# EAGLE board yrl040-bugfix1 (EAGLE 9.4.2), part 1 of 2 (continued)
## Tracks (layer width: path | path; a pad name or v marks a point on that pad's centre or on a via) (continued)
  Top 0.25: v30.4,68.9 30.5,68.9 30.8,69.2 36.45,69.2 37.25,70 37.25,70.5 36.9,70.85 36.05,70.85 v36,70.9 | v53.4,81 53,81 52.24,80.24 48.34,80.24 47.01,78.91 47.01,78.84 44.56,76.4 v43.8,76.4 43.8,75.1 v47.1,71.8
  Top 0.254: 38.9,3.7 39.6,3.7 v39.9,3.4
  Top 0.3: LED5.1 5.15,83.9 5.37,83.9 5.55,84.08 5.55,86.03 5.6,86.08
  Top 0.305: J19.+5V 20.54,81.96 19.57,82.94 14.52,82.94 13.45,84 13.45,85.03 12.61,85.88 12.2,85.88 12,86.08 5.6,86.08 2.15,86.08 v2.06,86.17 | 32.57,4 38.01,4 38.31,3.7 38.9,3.7
  Top 0.406: v3.69,9.09 1.25,6.65 v1.15,6.65 | J5.V+_1 34.74,29.6 33.94,30.4 30.73,30.4 29.93,29.6 J4.V+_1 27.34,29.6 26.54,30.4 23.33,30.4 22.53,29.6 J3.V+_1 20.05,29.6 19.24,30.4 15.93,30.4 15.13,29.6 J2.V+_1 14.39,29 v4.19,29 | J10.3-VCC J11.3-VCC J12.3-VCC J13.3-VCC J14.3-VCC J15.3-VCC | v26,4.4 26,7.02 27.2,8.22 27.2,8.97 27.93,9.7 28.97,9.7 31.22,7.45 31.22,6.81 31.62,6.41 31.67,6.41 32.57,5.51 32.57,4 32.57,1.86 v33.8,0.62
  Bottom 0.15: 4.3,8.9 3.87,8.9 v3.69,9.09 | U9.8 49.39,14.64 49.66,14.37 55.02,14.37 55.05,14.4 | 55.1,28.1 50.1,28.1 49.9,28.3 U10.7 U10.8 | RA2.P$2 RA2.P$1 14.4,33.2 v12.6,31.4 | IC2.4 33.93,77.15 33.93,76.72 34.06,76.58 34.81,76.58 34.94,76.72 34.94,77.15 IC2.6 | 55.34,57.4 C31.1 | 25.95,80.25 RA10.P$4 | v31.8,76.1 31.32,76.58 30.86,76.58 30.2,77.25 30.2,79.25 C29.1 | IC1.4 43.85,76.45 v43.8,76.4 | U8.7 5.88,28.97 5.88,29.66 5.75,29.79 5.29,29.79 4.5,29 v4.19,29
  Bottom 0.2: 53.4,85.5 53.36,85.54 | IC2.6 35.22,77.43 v35.22,76.58 | v36,70.9 36,68.89 IC2.18 | IC2.4 33.64,76.64 33.52,76.53 32.47,76.53 32.04,76.1 v31.8,76.1 | 25.95,80.25 25.66,79.96 25.66,79.8 25.51,79.65 23.29,79.65 23.14,79.8 23.14,80.52 J19.+5V | IC1.20 46.89,70.28 46.89,69.48 46.51,69.1 44.6,69.1 44.35,68.85 C32.1 | RA10.P$4 26.1,80.4 v27.65,80.4 | 39.4,0.37 39.51,0.37 39.65,0.5
  Bottom 0.24: 40.2,0.5 40.1,0.5 | v33.8,0.62 34.05,0.37 39.4,0.37 | v26,4.4 C3.P$2
  Bottom 0.25: C28.1 v30.4,68.9 | 55.6,81 v53.4,81 | v47.1,71.8 IC1.20 | IC1.20 | 3.3,86.6 2.71,86.6 2.42,86.52 v2.06,86.17
  Bottom 0.254: U12.8 51.92,66.58 52.83,66.58 53.69,67.44 U11.5 53.92,67.5 55.6,67.5 | R19.1 5.95,73.25 5.15,72.45 5.15,64.1 5.17,64.08 | v39.9,3.4 40.6,2.7 40.6,0.5
  Bottom 0.29: 5.83,37.5 6,37.67 U7.4 | 5.83,23.26 6,23.43 U8.4 | 50.07,20.9 49.9,20.73 U9.4 | 50.07,35.14 49.9,34.97 U10.4
  Bottom 0.3: 5.17,64.08 6.8,62.45 6.8,57.3 6.8,57.27 | 55.34,58.1 55.34,58.24 55.6,58.5 55.6,67.5 55.6,81 55.6,83.3 53.4,85.5 | 53.36,85.54 v53.34,85.56 52.3,86.6 3.3,86.6
  Bottom 0.305: U1.3 25.94,5.56 | 25.94,5.56 C3.P$2 | 25.94,5.56 25.94,5.71 27,6.78 27,8.22 26.82,8.4 25.18,8.4 24.21,7.44 U1.1
  Bottom 0.34: U5.28 27.52,55.92 27.7,56.1
  Bottom 0.35: U3.6 6.62,10.57 C7.2 5.67,10.15 4.92,10.9 4.09,10.9 3.5,10.31 3.5,9.49 4.09,8.9 4.3,8.9 6.3,8.9 C6.P$2
  Bottom 0.406: 5.83,37.5 5.33,37.5 4.41,38.42 C16.1 3.84,38.19 3.62,38.19 2.93,37.5 2.93,37.4 C20.1 | 5.83,23.26 5.33,23.26 4.41,24.18 C17.1 3.84,23.95 3.62,23.95 2.93,23.26 2.93,23.16 C21.1 | 50.07,20.9 50.57,20.9 51.49,19.98 C22.1 52.06,20.21 52.28,20.21 52.97,20.9 52.97,21 C24.1 | 50.07,35.14 50.57,35.14 51.49,34.22 C23.1 52.06,34.45 52.28,34.45 52.97,35.14 52.97,35.24 C25.1 | J2.V+_1 14.99,24.91 J10.3-VCC | C11.1 34.9,24.7 J14.3-VCC | v4.19,29 3.98,29 3.38,29.6 2.82,29.6 2.62,29.4 0.8,29.4 | 39.65,0.5 40.1,0.5
  Bottom 0.5: C3.P$2 25.1,4.6 19.57,4.6 19.47,4.5 17.7,4.5 16.4,3.2 8.11,3.2 4.76,6.55 1.25,6.55 v1.15,6.65 0.8,7 0.8,22.5 | 55.05,22.8 55.1,22.85 55.1,28.1 55.1,35.9 | 0.8,22.5 0.8,29.4 0.8,35.55 0.84,35.6 0.8,35.64 0.8,45.3 1.3,45.8 1.3,46.4 0.5,47.2 0.5,56 1.8,57.3 6.8,57.3 | C21.1 2.19,22.5 0.8,22.5 | 50.83,6.57 52.06,7.8 52.39,7.8 55.05,10.46 55.05,10.8 | 6.8,57.27 7.94,57.27 J6.5V-1 J6.5V-2 | F4.1 47.8,47.83
  Bottom 0.508: 0.84,35.6 1.33,36.09 1.61,36.09 C20.1 | C24.1 54.28,22.32 54.57,22.32 55.05,22.8 55.05,14.4 55.05,10.8 | 50.83,6.57 49.15,4.89 49.15,1.85 47.8,0.5 40.6,0.5 40.2,0.5 | C25.1 53.71,35.9 55.1,35.9
  Bottom 0.6: 27.7,56.1 28.05,56.45
  Bottom 0.61: 55.34,55.7 54.8,55.7
  Bottom 0.68: 14.71,62.2 25.19,62.2 25.96,61.43 25.96,60.64 F1.2 26.7,59.45 27.16,58.99 27.23,58.99 27.52,58.7 27.52,58.63 C15.2 28.15,56.55 28.05,56.45
  Bottom 0.813: 55.34,58.1 55.34,57.4 55.34,55.7 55.34,48.28 54.89,47.83 55.23,47.48 55.23,45.65 55.15,45.57 55.15,22.76 55.12,22.74 55.12,19.93 55.13,19.93 55.13,17.87 55.05,17.8 55.05,10.46 | C10.1 14.41,62.5 | 14.41,62.5 14.71,62.2 | J6.5V-2 12.7,59.49 12.7,60.79 14.41,62.5
  Bottom 0.9: C15.2 28.95,58.8 29.02,58.8 29.82,59.61 39.2,59.61 39.49,59.9 F2.2
  Bottom 0.95: 54.89,47.83 47.8,47.83 33.98,47.83 32.17,46.02 32.02,46.02 J1.V5
  Bottom 1.016: F2.2 40.6,58.9 41.3,58.9 41.46,58.74 49.06,58.74 49.6,58.2 49.6,57.45 R20.2 49.65,56.85 50.8,55.7 54.8,55.7
+12V
  Bottom 0.813: F5.1 39.7,49.1 36.8,49.1 33.79,49.1 31.75,47.05 31.35,47.05 31.3,47 J1.V12
  Bottom 1.016: 36.8,49.1 36.8,53.94 39.43,56.58 39.78,56.58 F3.2
+12V_SERVO
  Bottom 0.61: F3.1 43.4,57.4 X4.2
A0  (via drill 0.35 pad 0.65)
  Top 0.15: v32.1,72.4 32.1,73.22 32.55,73.67 32.55,74.93 32.35,75.13 32.35,76.73 27.12,81.96 J19.A0
  Bottom 0.15: v32.1,72.4 32.04,72.34 IC2.23
A1  (via drill 0.35 pad 0.65)
  Top 0.15: 31.5,72.5 | v31.5,73.6 31.5,72.5 | 31.5,72.5 31.5,72.22 31.87,71.85 32.33,71.85 32.65,72.17 32.65,73.35 32.85,73.55 32.85,75.05 32.65,75.25 32.65,78 J19.A1
  Bottom 0.15: IC2.24 31.24,69.5 31.55,69.81 31.55,73.2 31.5,73.25 v31.5,73.6
A2
  Bottom 0.15: IC2.25 29.74,70.4 30.68,70.4 31.25,70.97 31.25,73.07 30.95,73.37 30.95,75.85 31.01,75.91 29.44,77.49 29.44,80.59 30.05,81.2 30.47,81.2 J19.A2
A3  (via drill 0.35 pad 0.65)
  Top 0.15: v30.7,71.2 32.1,71.2 33.15,72.25 33.15,81.34 J19.A3
  Bottom 0.15: IC2.26 29.79,71.2 v30.7,71.2
A6  (via drill 0.35 pad 0.65)
  Top 0.15: J19.A6 35.3,75.87 v35.3,71.6
  Bottom 0.15: v35.3,71.6 35.24,71.54 IC2.19
A7
  Bottom 0.15: IC2.22 32.84,73.41 32.1,74.15 31.77,74.15 31.45,74.47 31.45,74.97 32.5,76.03 35.45,76.03 35.63,76.2 37.25,76.2 38.65,77.6 38.65,79.48 40.23,81.06 41.76,81.06 42.06,81.36 43.33,81.36 J19.A7
ARDUINO_RESET  (via drill 0.35 pad 0.65)
  Top 0.15: v51.4,81.1 51.3,81.1 50.79,80.59 46.57,80.59 44.83,82.33 43.95,83.21 26.12,83.21 24.97,82.05 v24.97,81.57
  Bottom 0.15: J19.RST 17.89,84.5 18.79,83.6 23.23,83.6 23.28,83.55 24.73,83.55 25.05,83.23 25.05,81.65 v24.97,81.57 25.47,81.06 26.3,81.06 27.84,81.06 28.24,80.66 28.24,78.6 | 28.24,78.6 28.24,75 28.35,74.89 28.35,74.35 29.15,73.55 IC2.29 | 28.24,78.6 26.1,78.6 RA10.P$5 | C27.2 51.15,80.85 v51.4,81.1
AREF
  Bottom 0.15: IC2.20 34.73,68.56 34.73,68.13 34.86,68 38.75,68 C26.2
AUDIO_ON  (via drill 0.45 pad 0.75)
  Top 0.152: v8.4,5.53 9.03,5.53 9.35,5.85 16.15,5.85 17.4,7.1 17.4,7.47 v17.38,7.5
  Bottom 0.15: v17.38,7.5 16.52,8.36 16.52,13.04 R6.1 14.95,12.8 12.97,12.8 U3.1 | 12.9,38.52 12.9,38.09 13.59,37.41 13.59,33.47 11.56,31.44 | 7.2,15.3 8.77,15.3 9.74,16.27 9.74,18.26 11.46,19.98 11.46,31.34
  Bottom 0.152: J1.AUDIO_ON 16.93,43.87 13.61,43.87 12.9,43.17 12.9,38.52 | 11.46,31.34 11.56,31.44 | 7.2,15.3 2.27,15.3 2.08,15.1 2.08,7.95 2.2,7.83 5.29,7.83 7.6,5.53 v8.4,5.53
AUDIO_OUT
  Bottom 0.15: 11.35,31.66 11.16,31.47 11.16,31.22 11.16,20.1 9.44,18.38 9.44,16.39 8.65,15.6 7.8,15.6
  Bottom 0.152: R1.1 12.23,4.38 8.32,4.38 5.17,7.53 2.05,7.53 1.78,7.8 1.78,15.28 2.1,15.6 7.8,15.6 | 11.35,31.66 11.41,31.72 11.41,37.45 12.6,38.64 12.6,43.29 13.48,44.17 14.4,44.17 15.23,45 J1.AUDIO
CE0  (via drill 0.35 pad 0.65)
  Top 0.15: J19.CE0 9.64,83.23 10.54,82.33 10.54,81.59 10.01,81.06 3.01,81.06 1.23,79.28 1.23,63.88 v1.6,63.5 | v9.1,45.7 8.53,45.7 8.4,45.83 7.58,45.83 6.9,46.5 6.9,46.88 6.58,47.2 4.8,47.2 2.9,49.1 1.1,49.1 0.62,49.58 0.62,56.37 1.12,56.87 1.12,57.45 v0.57,58
  Bottom 0.15: J1.CE0 11.23,45 10.4,45.83 9.22,45.83 v9.1,45.7 | v1.6,63.5 2.9,63.5 3.12,63.27 4.24,63.27 5.28,62.23 5.28,59.77 v4.5,59 1.82,59 1.55,58.73 1.3,58.73 v0.57,58
CE1  (via drill 0.35 pad 0.65)
  Top 0.15: v3.62,73.84 7.66,73.84 14.72,66.78 14.72,57.27 14.42,56.98 14.42,54.86 13.95,54.39 13.95,47.11 J1.CE1
  Bottom 0.15: J19.CE1 6.54,81.4 3.18,81.4 2.9,81.12 2.9,74.56 v3.62,73.84
D0  (via drill 0.35 pad 0.65)
  Top 0.15: v24.5,83 26,84.5 J19.D0
  Bottom 0.15: IC2.30 29.31,74.35 28.58,75.08 28.58,75.46 28.54,75.5 28.54,80.83 27.05,82.33 26.15,83.23 J19.D0 | RA10.P$2 24.4,82.9 v24.5,83
D1  (via drill 0.35 pad 0.65)
  Top 0.15: J19.D1 27.42,84.5 26.52,85.4 25.77,85.4 25.25,84.87 25.25,84.55 v23.7,83
  Bottom 0.15: J19.D1 28.69,83.24 29.59,82.34 29.59,81.59 28.84,80.84 28.84,75.62 29.31,75.15 IC2.31 | RA10.P$1 23.6,82.9 v23.7,83
D2
  Bottom 0.15: J19.D2 31.23,83.23 29.89,81.89 29.89,81.46 29.14,80.72 29.14,76.56 IC2.32
D3
  Bottom 0.15: J19.D3 32.13,82.86 32.13,81.59 31.6,81.06 31.54,81.06 30.65,80.17 30.65,78.81 30.58,78.74 30.58,78.1 IC2.1
D4
  Bottom 0.15: J19.D4 35.41,83.6 33.29,83.6 32.43,82.74 32.43,81.46 31.72,80.76 31.66,80.76 30.95,80.05 30.95,78.68 31.33,78.31 31.61,78.31 31.74,78.17 31.74,77.74 IC2.2
D5
  Bottom 0.15: IC2.9 38.95,76.58 38.95,79.36 40.35,80.76 41.88,80.76 42.18,81.06 44.35,81.06 44.83,81.54 44.83,82.33 43.96,83.2 40.15,83.2 J19.D5
D6
  Bottom 0.15: IC2.10 38.95,75.15 39.25,75.45 39.25,79.23 40.48,80.46 42.01,80.46 42.31,80.76 44.48,80.76 45.13,81.41 45.13,82.46 44.08,83.5 42.39,83.5 J19.D6
D7
  Bottom 0.15: IC2.11 37.95,74.35 37.8,74.2 39.2,74.2 39.55,74.55 39.55,79.11 40.6,80.16 42.13,80.16 42.43,80.46 44.6,80.46 45.43,81.29 45.43,82.58 43.93,84.08 J19.D7
D8
  Bottom 0.15: IC2.12 38.38,73.5 39.4,73.5 39.85,73.95 39.85,78.98 40.73,79.86 42.26,79.86 42.56,80.16 44.76,80.16 45.66,81.06 46.84,81.06 47.37,81.59 47.37,82.83 46.47,83.73 J19.D8
D9
  Bottom 0.15: IC2.13 38.36,72.72 39.6,72.72 40.15,73.28 40.15,78.86 40.85,79.56 42.38,79.56 42.68,79.86 44.89,79.86 45.79,80.76 46.96,80.76 47.2,81 47.7,81 48.11,81.41 48.11,82.33 49.01,83.23 J19.D9
D10
  Bottom 0.15: IC2.14 38.37,71.91 39.49,71.91 40.1,72.52 40.1,72.6 40.45,72.95 40.45,78.74 40.98,79.26 42.5,79.26 42.8,79.56 45.01,79.56 45.91,80.46 47.09,80.46 47.33,80.7 47.82,80.7 48.5,81.37 48.52,81.37 49.01,81.86 J19.D10
D11  (via drill 0.35 pad 0.65)
  Top 0.15: J19.D11 20,81.96 20.9,81.06 22.07,81.06 22.8,81.79 22.8,84.38 24.12,85.7 26.64,85.7 26.97,85.37 28.28,85.37 28.31,85.4 44.3,85.4 45.57,84.13 46.09,83.6 46.1,83.6 48.11,81.59 48.63,81.06 49.38,81.06 49.46,81.14 v50.56,81.14 | v51.5,64.85 48.05,68.3 40.7,68.3 v36.8,72.2
  Bottom 0.15: 38.33,71.2 IC2.15 | 38.33,71.2 38.43,71.1 39.1,71.1 40.4,72.4 40.4,72.47 40.75,72.83 40.75,78.61 41.1,78.96 42.63,78.96 42.93,79.26 45.14,79.26 46.04,80.16 47.21,80.16 47.45,80.4 47.95,80.4 48.61,81.06 49.38,81.06 49.46,81.14 v50.56,81.14 | U12.1 50.55,64.85 v51.5,64.85 51.8,64.55 52.81,64.55 52.94,64.68 52.94,65.1 U11.2 | v36.8,72.2 37.8,71.2 38.33,71.2
D12  (via drill 0.35 pad 0.65)
  Top 0.15: v23.7,84.5 23.1,83.9 23.1,81.66 22.16,80.72 22.08,80.72 21.77,80.42 | v32,74.7 32,75 31.8,75.2 30.72,75.2 28.02,77.9 22.9,77.9 21.77,79.03 21.77,80.42 | v9.7,74.3 9.3,74.7 9.3,79.68 10.04,80.42 18.3,80.42 18.37,80.35 18.82,80.35 18.89,80.42 21.77,80.42
  Bottom 0.15: J19.D12 v23.7,84.5 | v32,74.7 33.4,74.7 37.75,70.35 IC2.16 | v9.7,74.3 9.8,74.2 RA13.P$4
D13  (via drill 0.35 pad 0.65)
  Top 0.15: v49.67,83.2 49.92,83.45 49.92,85.88 49.73,86.08 20.74,86.08 J19.D13 18.9,84.5 v18,83.6 | v45,75.2 45.2,75.4 v50.9,75.4 | v8.9,74.3 8.9,79.7 9.96,80.76 10.13,80.76 10.17,80.8 17.8,80.8 17.9,80.9 v18.6,80.9
  Bottom 0.15: v49.67,83.2 50.7,83.2 52,81.9 52,79.04 51.88,78.92 51.88,78 50.9,77.03 v50.9,75.4 | IC2.17 38.24,68.86 38.63,69.25 39.3,69.25 41.3,71.24 41.3,72.1 44.4,75.2 v45,75.2 | RA13.P$3 9.44,73.17 9.31,73.17 8.9,73.57 v8.9,74.3 | v18,83.6 18,83.1 18.12,82.98 18.12,81.37 v18.6,80.9
D+
  Bottom 0.15: IC1.15 50.35,73.25 51.1,74 J18.3
D-
  Bottom 0.15: IC1.16 49.7,73.6 50.9,74.8 J18.2
EXT_ADC
  Bottom 0.15: U6.8 31.69,19.3 35.22,19.3 35.37,19.45 38.65,19.45 X2.1
FAULT_MOTOR1  (via drill 0.35 pad 0.65)
  Top 0.15: v29.6,35.4 29.6,34.2 28.74,33.34 15.2,33.34 14.59,33.95 14.59,42.56 13.84,43.3 9.68,43.3 8.93,42.54 5.56,42.54 v5,43.1
  Bottom 0.15: U13.13 30.76,35.4 v29.6,35.4 | U7.6 v5.01,43.09 v5,43.1
FAULT_MOTOR2  (via drill 0.35 pad 0.65)
  Top 0.15: v32.1,36.1 32.1,34.4 30.74,33.04 13.46,33.04 9.85,29.43 4.5,29.43 4.41,29.52 3.7,29.52 v3.1,28.92
  Bottom 0.15: v32.1,36.1 32.08,36.08 U13.14 | U8.6 4.79,28.85 4.41,28.48 3.55,28.48 v3.1,28.92
FAULT_MOTOR3  (via drill 0.35 pad 0.65)
  Top 0.15: v29.6,36.7 32.3,36.7 35.2,33.8 41,33.8 41.7,33.1 41.7,29 41.5,28.8 v41.5,28.5 | v51,15.3 46.2,15.3 45.8,15.7 45.8,18.85 46,19.05 46,19.55 45.65,19.9 42.5,19.9 41.8,20.6 41.8,22.2 v41.7,22.3
  Bottom 0.15: U13.15 29.61,36.71 v29.6,36.7 | U9.6 v50.99,15.31 v51,15.3 | v41.7,22.3 41.7,28.3 v41.5,28.5
FAULT_MOTOR4  (via drill 0.35 pad 0.65)
  Top 0.15: v32.1,37.4 35.4,34.1 41.12,34.1 42,33.22 42,30.2 42.7,29.5 v51,29.5
  Bottom 0.15: U13.16 32.07,37.37 v32.1,37.4 | v51,29.5 50.43,29.5 U10.6
GND  (via drill 0.35, 0.35 pad 0.65, 0.45 pad 0.75)
  Top 0.15: SW3.P$2 v46.6,4 | v43.6,4 43.23,3.62 43.23,2.94 43.09,2.81 43.06,2.77 | 43.06,2.77 43.04,2.75 | v7.69,50.69 v7.69,53.27 v7.68,53.28 | v11.5,74.4 10.44,75.46 VR1.P$1 | v28.2,54.8 28.3,54.9 29.04,54.9 | v18.9,48.6 22.65,52.35 22.65,52.53 22.97,52.85 23.43,52.85 23.75,52.53 23.75,52.37 29.04,47.08 | 43.06,2.77 40.76,2.77 40.7,2.83
  Top 0.2: SW6.2 35.5,49.6 | v39.2,80.81 40.46,82.07 40.46,82.34 41,82.89 41.77,82.89 43,81.65 43,81.58 45.49,79.09 v46.41,79.09
  Top 0.25: v52.4,57.4 52.7,57.1 v52.7,50.9
  Top 0.254: SW2.P$2 9.5,5.5 18.1,5.5 SW1.8 SW1.7 20.8,10.3 21.9,10.3 | 21.9,10.3 SW1.6 SW1.5 27.42,10.3 27.61,10.48 30.12,10.48 v31.8,8.8 | v21.9,10.2 21.9,10.3 | 14.4,20.26 14.32,20.34 | 14.32,20.34 14.32,20.94 13.88,21.38 | 0.4,3 0.38,3.02 0.38,10.98 2.5,13.1 2.95,13.1 3.3,13.45 3.3,14.03 3.6,14.33 3.6,15.07 2.68,16 v2.68,19.11 | 14.32,20.34 14.32,16.27 MIC1.3
  Top 0.3: J18.6 55.6,76.2 55.6,71.8 J18.7 53.6,70 53.6,71.5 J18.5
  Top 0.305: v9.5,6.6 9.1,6.2 8.12,6.2 7.72,5.81 7.72,5.24 8,4.97 SW2.P$2 8,3 5.4,0.4 3,0.4 2.55,0.44 2.11,0.56 1.7,0.75 1.46,0.92 0.92,1.46 0.75,1.7 0.56,2.11 0.44,2.55 0.4,3 | v9.43,41.5 10.33,42.4 v14,42.4 | v37.2,9.43 36.57,8.8 35.56,8.8
  Top 0.34: v23.8,43.95 27.89,43.95 28.44,44.5 28.5,44.5 J1.GND1
  Top 0.35: v6.33,21.06 8.31,21.06 8.63,21.38 13.88,21.38 J10.2-GND
  Top 0.406: v19.8,6.5 19.8,9.3 20.8,10.3 | v31.8,8.8 35.56,8.8 38.51,5.85 39.21,5.85 40.65,4.41 40.65,2.88 40.7,2.83 40.7,2.4 40.25,1.95 SW4.P4 | J3.GND_1 26.07,29.6 25.27,28.8 20.06,28.8 19.26,29.6 J2.GND_1 | v52.4,57.4 53.2,58.2 53.87,58.2 55.55,59.88 55.55,68.05 53.6,70
  Top 0.61: J21.P$1 45.03,64.63 44.58,64.63 43.92,63.97 43.92,62.83 42.96,61.87 42.96,57.76 42.67,57.47 42.67,55.63 44.6,53.7 v44.6,50.9
  Top 0.813: v53.22,39.29 55.34,41.41 55.34,50.36 54.8,50.9 v52.7,50.9 | 44.26,49.6 35.5,49.6 34.2,49.6 33,48.4 29,48.4
  Top 0.9: v52.7,50.9 51.96,50.16 v51.96,49.9 51.66,49.6 47.21,49.6 46.98,49.83 46.22,49.83 45.99,49.6 44.26,49.6 v43.96,49.9 43.96,50.26 v44.6,50.9
  Top 1.016: 3.38,26.31 2.28,25.21 | 2.67,19.1 2.27,19.47 | 52.54,17.83 53.63,18.92 53.63,24.69 53.24,25.07 | 52.52,32.09 53.62,33.19 | 53.23,39.3 53.61,38.93 53.62,33.14 | C25.2 53.67,25.5 v53.22,25.05
  Top 1.27: J7.GND5 28.79,60.96 28.04,60.21 26.96,60.21 | J7.GND4 26.21,60.96 29.04,58.14 29.04,54.9 29.04,47.08
  Bottom 0.15: C4.1 13.65,9.4 12.55,9.4 11.62,8.47 | 11.62,8.47 R2.1 C2.1 | 10.25,10.55 U3.9 11.11,12.11 11.11,12.17 12.64,13.7 13,13.7 | 11.62,8.47 11.2,8.9 11.2,9.1 10.45,9.85 10.45,10.75 | C1.2 v14,42.4 | U2.21 19.93,40.43 23.45,43.95 v23.8,43.95 | v46.6,4 v43.6,4 | MIC1.2 15.7,16.69 MIC1.3 14.24,16.35 C13.1 | U13.2 U13.3 36.36,41.03 35.79,41.03 35.66,40.9 35.66,35.81 35.79,35.68 36.36,35.68 U13.12 | U15.2 7.65,50.65 | 3.3,51.3 3.63,51.3 4.51,52.17 6.94,52.17 7.38,51.74 7.38,50.92 7.65,50.65 | 7.65,50.65 v7.69,50.69 | v7.68,53.28 7.7,53.3 8.01,53.3 U15.6 8.5,52.81 8.5,52.63 8.68,52.45 10.35,52.45 | U15.25 10.2,49.69 10.2,49.51 9.44,48.75 6.3,48.75 6.03,49.02 4.51,49.02 3.73,49.8 | U15.15 12.85,52.21 U15.16 10.65,52.15 10.35,52.45 | U15.10 10.35,52.45 | X3.2 35.76,80.21 35.76,80.33 35.62,80.46 34.84,80.46 34.44,80.06 34.44,78.4 | 34.44,78.4 IC2.5 | 34.44,78.4 34.34,78.31 33.26,78.31 33.13,78.17 33.13,77.74 IC2.3 32.84,78.11 C29.2 | 48.52,69.6 48.4,69.6 IC1.18 | IC1.18 | C26.1 40.8,68.5 40.8,67.95 40.55,67.7 33.9,67.7 33.64,67.96 33.64,68.3 IC2.21 | IC1.21 46.45,71.95 46.1,72.3 | 46.1,72.3 44.2,72.3 43.8,71.9 43.8,70.49 | IC1.18 48.4,72 48.05,72.35 46.87,72.35 46.82,72.3 46.1,72.3 | 46.1,72.3 46.1,74.9 45.8,75.2 IC1.7 | LED11.4-GREEN-CATHODE LED11.2_RED-CATHODE 15.55,75.7 | v11.5,74.4 12.18,75.08 12.18,75.09 12.78,75.7 15.55,75.7 | 15.55,75.7 16.5,76.65 LED9.4-GREEN-CATHODE | U5.24 24.93,54.17 25.37,53.73 27.13,53.73 27.66,54.26 27.79,54.26 27.92,54.39 27.92,54.52 v28.2,54.8 | J1.GND2 27.52,48.48 U5.1 U5.2 U5.3 U5.4 U5.5 | U5.14 19.08,48.78 v18.9,48.6 | U5.25 U5.24 | U5.23 U5.24 | 6.94,53.24 C38.P$1
  Bottom 0.15: 3.3,52.03 2.73,52.61 2.73,54.23 C37.P$1 | U15.18 U15.17
  Bottom 0.152: U7.7 6,41.42 U7.11 U7.8 | U8.8 U8.11 | U9.11 49.9,16.98 U9.7
  Bottom 0.2: U2.1 24.5,42.3 24.5,41.8 | X3.2 37.08,80.19 37.08,80.34 37.55,80.81 v39.2,80.81 | v46.41,79.09 45.8,78.48 IC1.7 | C26.1 41.55,69.1 43.1,69.1 43.2,69.2 IC1.26 43.8,70.49 IC1.25 | 33.64,68.3 33.26,67.92 29.08,67.92 28.52,68.49 28.46,68.49 C28.2 | C32.2 41.15,68.6 41.08,68.67 | IC1.18 48.19,70.28 48.19,69.48 47.93,69.22 47.13,69.22 46.51,68.6 46.1,68.6 45.75,68.25 C30.2 46.4,67.25 J21.P$1
  Bottom 0.203: R6.2 13,13.7 | 52.4,66.1 52.82,66.1 52.92,66.19 54.14,66.19 54.24,66.1 54.3,66.1
  Bottom 0.25: U11.3 52.5,65.4 52.5,66 52.4,66.1 49.3,66.1 48.85,65.65 U12.4 | 54.3,66.1 54.9,65.5 54.9,59.5 52.95,57.55 C31.2 v52.4,57.4 | C26.1 41.08,68.62 41.08,68.67 41.8,67.95 42.21,67.95 43.34,66.82 43.34,66.4 43.74,66 J21.P$1
  Bottom 0.254: U4.12 31.78,8.78 v31.8,8.8 | v37.2,9.43 37.2,10.65 C9.1 | U4.3 31.79,2.91 32.1,2.6 | 32.1,2.6 31.78,2.28 U4.2 | 32.1,2.6 33.07,3.57 U4.21 | LED1.CATHODE LED2.CATHODE 21.9,10.9 | 21.9,10.9 LED3.CATHODE LED4.CATHODE | 21.9,10.9 v21.9,10.2 | 35.52,15.9 U6.12 U6.13 35.64,14.55 C18.2 C19.2 | 35.52,15.9 U6.11 | 35.52,15.9 35.25,16.17 34.67,16.17 34.51,16.33 34.51,16.92 34.88,17.29 U6.9 | 24.5,41.8 26.2,41.8 26.29,41.89 27.42,41.89 27.55,41.76 | C13.1 C14.1 | 25.88,34.79 27.4,34.79 27.55,34.94 | U8.8 6.51,31.16 6.6,31.25
  Bottom 0.29: U7.5 5.2,38.73 5.03,38.9 | U8.5 5.2,24.49 5.03,24.66 | U9.5 50.7,19.67 50.87,19.5 | U10.5 50.7,33.91 50.87,33.74
  Bottom 0.3: C36.2 8.84,61.49 U14.5
  Bottom 0.305: C8.P$1 19.6,6.5 v19.8,6.5 U1.2 25,6.5 C3.P$1 | C6.P$1 v9.5,6.6 | U2.12 25.45,35.22 25.88,34.79 | 24.5,41.8 U2.2 | SW4.P4 37.56,3.14 37.56,3.22 37.2,3.57 U4.21
  Bottom 0.34: 27.55,41.76 27.55,42.19 27.53,42.22 27.53,43.58 27.72,43.77 27.77,43.77 J1.GND1 | U13.12 36.62,33.68 36.8,33.5
  Bottom 0.35: C7.1 6.62,11.23 U3.7 9.57,11.23 U3.9 | C6.P$1 9.5,9.8 10.25,10.55 10.45,10.75 | C18.2 37.45,14.4 | 43.3,16.5 43.3,20 42.98,20.32 42.84,20.32 42.22,20.95 42.22,21.09 41.65,21.65 41.43,21.65 41.05,22.03 41.05,22.25 40.6,22.7 J15.2-GND J14.2-GND J13.2-GND J12.2-GND J11.2-GND J10.2-GND 12.8,25.1 C12.2
  Bottom 0.36: C18.2 41.33,14.55 41.48,14.39 42.9,14.39 X2.2 43.3,16 43.3,16.5
  Bottom 0.4: 36.48,29.18 36.4,29.27 36.4,31.2 36.23,31.37 34.54,31.37 34.44,31.48 34.17,31.48 33.6,30.91 J4.GND_1
  Bottom 0.406: 5.03,38.9 4.07,39.86 | 4.07,39.86 C16.2 | C20.2 2.59,39.86 4.07,39.86 | 5.03,24.66 4.07,25.62 | 4.07,25.62 C17.2 | C21.2 2.59,25.62 4.07,25.62 | 50.87,19.5 51.83,18.54 | 51.83,18.54 C22.2 | C24.2 53.31,18.54 51.83,18.54 | 50.87,33.74 51.83,32.78 | 51.83,32.78 C23.2 | C25.2 53.31,32.78 51.83,32.78 | 40.6,22.7 40.6,24.25 40.65,24.3 40.65,27.1 | J5.GND_1 40.65,29.25 40.65,27.1 | J5.GND_1 42.1,30.7 | 42.1,30.7 42.55,31.14 v46.47,31.14 | C11.2 40.65,27.1 | 26.07,29.6 J3.GND_1 28.66,29.6 29.46,28.8 32.67,28.8 33.47,29.6 J4.GND_1 | 36.48,29.18 36.86,28.8 40.2,28.8 J5.GND_1 | 27.55,41.76 27.55,34.94 27.35,34.74 27.71,34.37 33.04,34.37 34.71,32.7 34.84,32.7 35.02,32.52 36.32,32.52 37.3,33.5 | 42.1,30.7 41.4,31.4 41.4,32.57 40.46,33.5 37.3,33.5 | 37.3,33.5 36.8,33.5 | J6.GND 12.43,57.77 11.1,56.44 3.5,56.44 | 3.4,56.44 2.14,56.44 1.1,55.4 1.1,47.45 1.9,46.65 1.9,44.7 1.87,44.67 1.87,42.06 v2.43,41.5 | J19.GND 13.63,81.96 12.6,80.93 11.13,80.93 10.4,80.2 10.4,75.31 10.07,74.98 8.62,74.98 8.22,74.58 8.22,73.64 9,72.87 9,70.19 11.99,67.2 11.99,66.66 C36.2 | 10.4,76.78 VR1.P$1
  Bottom 0.5: J1.GND2 J1.GND1 29.19,45 30.19,44 32.45,44 C33.1 35.59,46.05 36.22,45.42 53.58,45.42 54.22,44.78 v54.22,39.29
  Bottom 0.65: Q2.2-S 44.44,50.74 v44.6,50.9 | Q1.2-S 52.54,50.74 v52.7,50.9
  Bottom 0.813: Q1.2-S v51.96,49.9 51.96,49.31 R23.1 | Q2.2-S v43.96,49.9 43.96,49.31 R30.1 | 13.52,58.32 13.52,58.92 C10.2
  Bottom 0.9: C15.1 26.05,58.6 26,58.6
  Bottom 1.016: R13.1 6.6,31.25 R11.1 | R14.1 R12.1 | 53.23,25.07 51.15,27.15 R15.1 R17.1 | R16.1 51.14,41.38 v53.23,39.3 | R18.1 R16.1 | 26,58.6 24.31,60.29 J7.GND4
  Bottom 1.5: J7.GND4 J7.GND3 J7.GND2 J7.GND1 16.69,60.24 16.14,59.7 14.9,59.7 | J7.GND8 J7.GND7 J7.GND6 J7.GND5 | J6.GND 13.52,58.32
  Bottom 1.6: 6.51,40.7 3.43,40.7 | 6.51,26.46 3.43,26.46 | 3.38,26.31 2.28,25.21 | 49.39,17.7 52.47,17.7 | 52.52,17.85 53.62,18.95 | 49.39,31.93 52.47,31.93 | 52.52,32.09 53.62,33.19
  other vias: 3.43,40.5 2.68,33.35 6.33,36.2 6.33,35.3 5.43,35.3 5.43,36.2 4.63,35.75 3.63,35.74 2.68,35.25 2.68,34.3 1.68,34.3 1.68,35.25 1.68,33.35 6.43,41.5 7.43,41.5 5.43,41.5 4.43,41.5 7.43,40.5 6.43,40.5 5.43,40.5 4.43,40.5 3.43,41.5 2.43,40.5 8.43,41.5 8.43,40.5 9.43,40.5 3.43,26.26 6.33,21.96 5.43,21.06 5.43,21.96 4.63,21.51 3.63,21.5 2.68,21.01 2.68,20.06 1.68,20.06 1.68,21.01 1.68,19.11 6.43,27.26 7.43,27.26 5.43,27.26 4.43,27.26 2.43,27.26 7.43,26.26 6.43,26.26 5.43,26.26 4.43,26.26 3.43,27.26 2.43,26.26 8.43,27.26 9.43,27.26 8.43,26.26 9.43,26.26 52.47,17.9 49.57,22.2 49.57,23.1 50.47,23.1 50.47,22.2 51.27,22.65 52.27,22.66 53.22,23.15 53.22,24.1 54.22,24.1 54.22,23.15 54.22,25.05 49.47,16.9 48.47,16.9 50.47,16.9 51.47,16.9 53.47,16.9 48.47,17.9 49.47,17.9 50.47,17.9 51.47,17.9 52.47,16.9 53.47,17.9 47.47,16.9 46.47,16.9 47.47,17.9 46.47,17.9 52.47,32.14 49.57,36.44 49.57,37.34 50.47,37.34 50.47,36.44 51.27,36.89 52.27,36.9 53.22,37.39 53.22,38.34 54.22,38.34 54.22,37.39 49.47,31.14 48.47,31.14 50.47,31.14 51.47,31.14 53.47,31.14 48.47,32.14 49.47,32.14 50.47,32.14 51.47,32.14 52.47,31.14 53.47,32.14 47.47,31.14 47.47,32.14 46.47,32.14
  pour Bottom (isolate 0.24, rank 6, no thermals): 55.9,-0.2 56,47.7 56,84 arc90 53,87 3,87 arc90 0,84 0,0
  pour Top (no thermals): 1.43,42.5 9.73,42.5 9.73,16.26 1.43,16.26
  pour Bottom (no thermals): 1.43,42.5 9.73,42.5 9.73,16.26 1.43,16.26
  pour Top (no thermals): 54.47,15.9 46.17,15.9 46.17,42.14 54.47,42.14
  pour Bottom (no thermals): 54.47,15.9 46.17,15.9 46.17,42.14 54.47,42.14
  pour Top (rank 6): -2,88 -2,-2 56,-2 58,-2 58,88
I2S_BCLK  (via drill 0.35 pad 0.65)
  Top 0.15: v2.7,14.7 2.4,15 2.38,15 0.33,17.05 0.33,42.62 1.9,44.2 v3,44.2
  Bottom 0.15: R9.1 3,14.4 v2.7,14.7 | J1.I2S_B 19.23,47 18.4,47.83 14.18,47.83 13.53,48.48 11.59,48.48 11.21,48.09 10.94,47.83 10.1,47.83 7.72,47.83 7.24,47.34 7.24,46.34 6.37,45.47 5.49,45.47 4.66,44.64 4.66,44.31 4.35,44 4.35,43.97 4.03,43.65 3.57,43.65 3.02,44.2 v3,44.2
I2S_DATA  (via drill 0.35 pad 0.65)
  Top 0.15: v16.1,20.07 v16.1,23.8 | v20.7,42.9 20.99,42.61 v20.99,38.51
  Bottom 0.15: R10.2 15.65,19.62 v16.1,20.07 | v20.7,42.9 20.7,44.47 20.89,44.66 20.89,45.4 21.5,46.02 21.5,46.44 J1.I2S_D | v20.99,38.51 20.74,38.26 20.74,34.45 19.48,33.19 19.48,29.32 19.06,28.9 17,28.9 16.1,28 v16.1,23.8
I2S_WS  (via drill 0.35 pad 0.65)
  Top 0.15: v2.7,13.7 2.7,13.92 3.25,14.47 3.25,14.93 2.88,15.3 2.5,15.3 0.62,17.18 0.62,42.5 1.77,43.65 3.25,43.65 v3.8,44.2 | v20.91,47.79 21.23,47.47 21.23,46.66 22.06,45.83 J1.I2S_W
  Bottom 0.15: R8.1 16.23,16.98 16.23,15.75 15.23,14.75 13.85,14.75 13,15.6 10.75,15.6 10.35,15.2 10.35,13.81 10.22,13.68 7.78,13.68 7.36,14.1 3.1,14.1 v2.7,13.7 | v20.91,47.79 20.57,48.12 19.2,48.12 19.13,48.05 18.67,48.05 18.6,48.12 14.3,48.12 13.65,48.77 11.46,48.77 10.81,48.12 7.59,48.12 6.93,47.47 6.93,46.46 6.25,45.77 5.37,45.77 4.36,44.76 4.36,44.43 4.13,44.2 v3.8,44.2
IO_INT  (via drill 0.35 pad 0.65)
  Top 0.15: J1.GPIO6 16.89,47 18.07,45.83 18.4,45.83 18.89,45.34 18.89,45.01 19.72,44.17 22.4,44.17 22.89,44.66 22.89,44.99 23.72,45.83 29.55,45.83 29.77,46.05 30.23,46.05 30.45,45.83 31.34,45.83 31.82,45.34 31.82,45.27 33.5,43.6 36.5,43.6 v37.9,42.2
  Bottom 0.15: U13.1 37.4,42.58 | 37.4,42.58 37.52,42.58 v37.9,42.2 | R21.1 42.9,41.5 42.6,41.8 40.4,41.8 39.57,42.63 39.57,43.57 39.02,44.12 38.24,44.12 37.4,43.28 37.4,42.58
LED
  Bottom 0.2: J19.LED 6.45,85.15 3.54,85.15 3,84.61 3,81.68 2.55,81.23 2.55,73.2 3.55,72.2 RA12.P$4
LED1
  Bottom 0.15: U4.16 36.26,7.08 35.54,7.08 34.75,7.87 34.75,8.33 35,8.58 RA5.P$1
LED2
  Bottom 0.15: U4.17 36.26,6.42 35.69,6.42 34.2,7.91 RA5.P$2
LED3
  Bottom 0.15: RA5.P$3 33.77,9.54 33.77,7.69 35.69,5.76 36.29,5.76 U4.18
LED4
  Bottom 0.15: RA5.P$4 32.97,9.54 32.97,7.85 35.69,5.13 36.26,5.13 U4.19
LED_B_G  (via drill 0.35 pad 0.65)
  Top 0.2: v53.5,83.2 53.55,83.25 LED6.3
  Bottom 0.2: v53.5,83.2 52.95,82.65 52.27,82.65 51.95,82.97 51.95,85.6 51.7,85.85 3.25,85.85 2.3,84.91 2.3,81.97 1.85,81.52 1.85,72 3.25,70.6 RA12.P$2
LED_B_R  (via drill 0.35 pad 0.65)
  Top 0.2: LED6.4 51.55,83.3 v52.7,83.3
  Bottom 0.2: v52.7,83.3 52.67,83.3 52.67,85.67 52.13,86.2 3.1,86.2 1.95,85.05 1.95,82.12 1.5,81.67 1.5,71.6 3.3,69.8 RA12.P$1
LED_L_B  (via drill 0.35 pad 0.65)
  Top 0.2: v1.02,82.5 1.02,82.78 LED5.2
  Bottom 0.2: v1.02,82.5 0.8,82.28 0.8,70.56 4.07,67.3 RA11.P$4
LED_L_G  (via drill 0.35 pad 0.65)
  Top 0.2: v0.7,84.7 0.75,84.75 LED5.3
  Bottom 0.15: 1.4,69.2 1.45,69.15
  Bottom 0.2: v0.7,84.7 0.45,84.45 0.45,70.15 1.4,69.2 | 1.45,69.15 3.45,67.15 3.45,66.99 3.6,66.84 3.76,66.84 RA11.P$3
LED_L_R  (via drill 0.35 pad 0.65)
  Top 0.2: v1.36,85.78 1.58,85.55 2.35,85.55 2.5,85.4 2.5,85.1 2.85,84.75 LED5.4
  Bottom 0.2: v1.36,85.78 1.6,85.53 1.6,82.26 1.15,81.81 1.15,70.71 2.52,69.34 4.06,69.34 4.75,68.65 4.75,66.19 4.6,66.04 4.44,66.04 RA11.P$2
LED_R_B  (via drill 0.35 pad 0.65)
  Top 0.2: v53.5,84.5 53.75,84.75 LED6.2
  Bottom 0.2: v53.5,84.5 53.5,84.01 54.08,83.44 54.08,82.96 53.41,82.3 52.13,82.3 51.6,82.83 51.6,85.3 51.4,85.5 3.39,85.5 2.65,84.76 2.65,81.83 2.2,81.38 2.2,72.5 3.3,71.4 RA12.P$3
LED_RX  (via drill 0.35, 0.35 pad 0.65)
  Top 0.15: v44.95,71.78 46.12,70.6 50.4,70.6 51.88,72.08 51.88,78.92 52.88,79.92 53.92,79.92 54.4,80.4 54.4,82 53.92,82.47 50.66,82.47 50.52,82.61 50.52,86.38 50.23,86.67 16.4,86.67 14.85,85.13 14.85,84.67 15.35,84.18 v15.35,83.92
  Bottom 0.15: IC1.23 45.15,71.57 v44.95,71.78 | v15.35,83.92 15.35,83.83 16.01,83.16 17.51,83.16 17.82,82.85 17.82,81.07 17.51,80.76 13.46,80.76 12.9,80.2 12.23,80.2 11.7,79.68 11.7,79.62 11.4,79.32 11.4,77.44 11.62,77.23 11.62,76.76 11.7,76.68 11.7,75.48 10.8,74.58 10.8,71.07 11.85,70.03 15.27,70.03 16.2,70.95 LED10.4-GREEN-CATHODE
LED_TX  (via drill 0.35 pad 0.65)
  Top 0.15: v45.8,71.75 46.65,70.9 50.27,70.9 51.58,72.2 51.58,79.04 52.76,80.22 53.8,80.22 54.1,80.52 54.1,81.88 53.8,82.17 50.53,82.17 50.23,82.48 50.23,86.05 49.9,86.38 16.88,86.38 v15.4,84.9